# Altium schematic sheet Slot_periph.SchDoc: CPCI-Serial Backplane
size 594 x 420 mm; Date: 06/04/2023; CheckedBy: EG; GD; GK; MS; DrawnBy: M. Gąska; Address1: European Organization for Nuclear Research; Address2: CH-1211 Geneve 23 - Switzerland; DocumentNumber: 5; Revision: 2; SheetNumber: 5; SheetTotal: 5; Title2: Slot periph; DivGrp: BE-CO; Projet: DI/OT Crate; Designer: G.Daniluk; ModifiedBy: J.Kuhn; CreateDate: 06/04/2023; CheckedDate: 06/04/2023
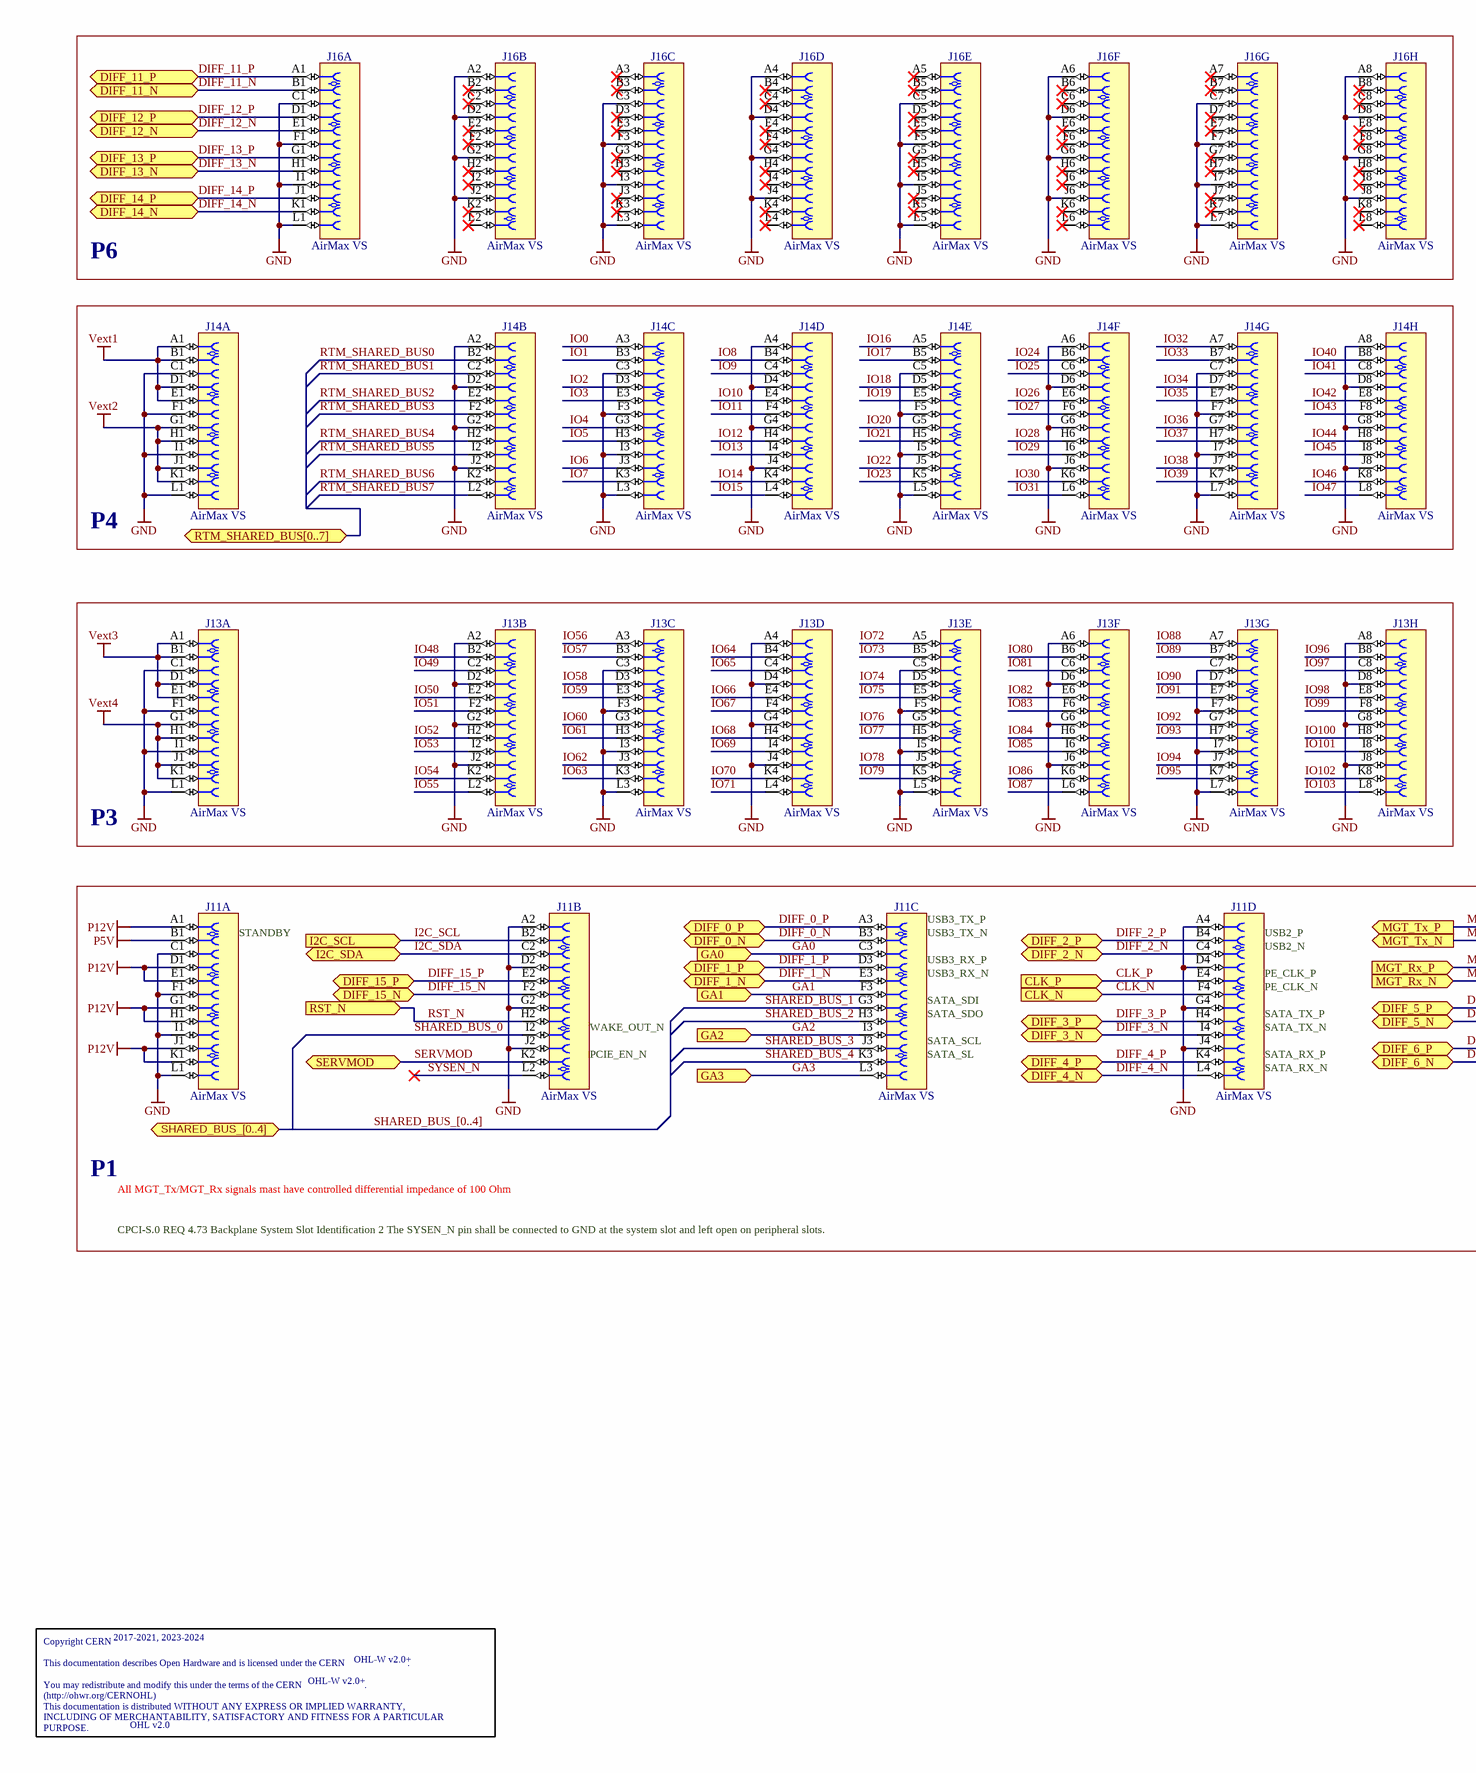
[diagram p0: Slot_periph.SchDoc, left]
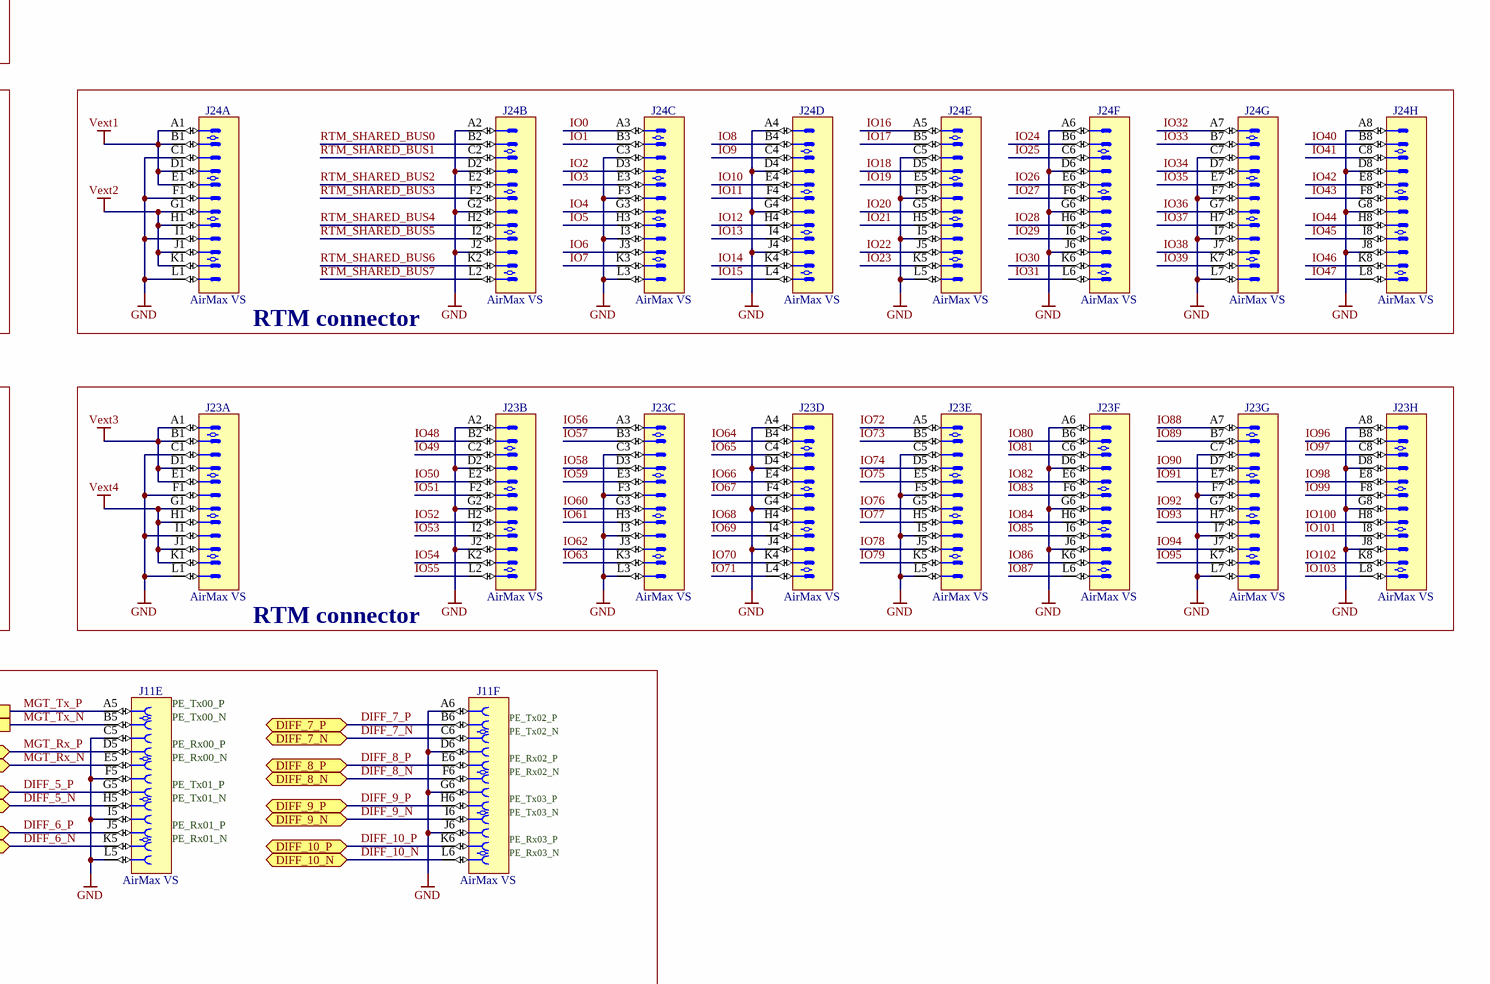
[diagram p1: Slot_periph.SchDoc, right]

## Parts
CERN_OHL  CERN_OHL  [CERN_OHL]  (value not drawn)  (graphical)
J11  AirMax VS  [AMPHENOL_10052829-101LF]  (parts A,B,C,D,E,F of 6)
J13  AirMax VS  [AMPHENOL_10052842-101LF]  (parts A,B,C,D,E,F,G,H of 8)
J14  AirMax VS  [AMPHENOL_10052842-101LF]  (parts A,B,C,D,E,F,G,H of 8)
J16  AirMax VS  [AMPHENOL_10052842-101LF]  (parts A,B,C,D,E,F,G,H of 8)
J23  AirMax VS  [AMPHENOL_10114760-101LF]  (parts A,B,C,D,E,F,G,H of 8)
J24  AirMax VS  [AMPHENOL_10114760-101LF]  (parts A,B,C,D,E,F,G,H of 8)

## Blocks framed on the sheet
P6: J16
P4: J14
RTM connector: J24
P3: J13
RTM connector: J23
P1: J11

## Ports
CLK_N (in), CLK_P (in), DIFF_0_N (bidir), DIFF_0_P (bidir), DIFF_1_N (bidir), DIFF_1_P (bidir), DIFF_2_N (bidir), DIFF_2_P (bidir), DIFF_3_N (bidir), DIFF_3_P (bidir), DIFF_4_N (bidir), DIFF_4_P (bidir), DIFF_5_N (bidir), DIFF_5_P (bidir), DIFF_6_N (bidir), DIFF_6_P (bidir), DIFF_7_N (bidir), DIFF_7_P (bidir), DIFF_8_N (bidir), DIFF_8_P (bidir), DIFF_9_N (bidir), DIFF_9_P (bidir), DIFF_10_N (bidir), DIFF_10_P (bidir), DIFF_11_N (bidir), DIFF_11_P (bidir), DIFF_12_N (bidir), DIFF_12_P (bidir), DIFF_13_N (bidir), DIFF_13_P (bidir), DIFF_14_N (bidir), DIFF_14_P (bidir), DIFF_15_N (bidir), DIFF_15_P (bidir), GA0 (in), GA1 (in), GA2 (in), GA3 (in), I2C_SCL (in), I2C_SDA (bidir), MGT_Rx_N (in), MGT_Rx_P (in), MGT_Tx_N (out), MGT_Tx_P (out), RST_N (in), RTM_SHARED_BUS[0..7] (bidir), SERVMOD (bidir), SHARED_BUS_[0..4] (bidir)

## Nets
GND: J11.A2 J11.A4 J11.A6 J11.C1 J11.C5 J11.D2 J11.D4 J11.D6 J11.F1 J11.F5 J11.G2 J11.G4 J11.G6 J11.I1 J11.I5 J11.J2 J11.J4 J11.J6 J11.L1 J11.L5 J13.A2 J13.A4 J13.A6 J13.A8 J13.C1 J13.C3 J13.C5 J13.C7 J13.D2 J13.D4 J13.D6 J13.D8 J13.F1 J13.F3 J13.F5 J13.F7 J13.G2 J13.G4 J13.G6 J13.G8 J13.I1 J13.I3 J13.I5 J13.I7 J13.J2 J13.J4 J13.J6 J13.J8 J13.L1 J13.L3 J13.L5 J13.L7 J14.A2 J14.A4 J14.A6 J14.A8 J14.C1 J14.C3 J14.C5 J14.C7 J14.D2 J14.D4 J14.D6 J14.D8 J14.F1 J14.F3 J14.F5 J14.F7 J14.G2 J14.G4 J14.G6 J14.G8 J14.I1 J14.I3 J14.I5 J14.I7 J14.J2 J14.J4 J14.J6 J14.J8 J14.L1 J14.L3 J14.L5 J14.L7 J16.A2 J16.A4 J16.A6 J16.A8 J16.C1 J16.C3 J16.C5 J16.C7 J16.D2 J16.D4 J16.D6 J16.D8 J16.F1 J16.F3 J16.F5 J16.F7 J16.G2 J16.G4 J16.G6 J16.G8 J16.I1 J16.I3 J16.I5 J16.I7 J16.J2 J16.J4 J16.J6 J16.J8 J16.L1 J16.L3 J16.L5 J16.L7 J23.A2 J23.A4 J23.A6 J23.A8 J23.C1 J23.C3 J23.C5 J23.C7 J23.D2 J23.D4 J23.D6 J23.D8 J23.F1 J23.F3 J23.F5 J23.F7 J23.G2 J23.G4 J23.G6 J23.G8 J23.I1 J23.I3 J23.I5 J23.I7 J23.J2 J23.J4 J23.J6 J23.J8 J23.L1 J23.L3 J23.L5 J23.L7 J24.A2 J24.A4 J24.A6 J24.A8 J24.C1 J24.C3 J24.C5 J24.C7 J24.D2 J24.D4 J24.D6 J24.D8 J24.F1 J24.F3 J24.F5 J24.F7 J24.G2 J24.G4 J24.G6 J24.G8 J24.I1 J24.I3 J24.I5 J24.I7 J24.J2 J24.J4 J24.J6 J24.J8 J24.L1 J24.L3 J24.L5 J24.L7
P5V: J11.B1
P12V: J11.A1 J11.D1 J11.E1 J11.G1 J11.H1 J11.J1 J11.K1
Vext1: J14.A1 J14.B1 J14.D1 J14.E1 J24.A1 J24.B1 J24.D1 J24.E1
Vext2: J14.G1 J14.H1 J14.J1 J14.K1 J24.G1 J24.H1 J24.J1 J24.K1
Vext3: J13.A1 J13.B1 J13.D1 J13.E1 J23.A1 J23.B1 J23.D1 J23.E1
Vext4: J13.G1 J13.H1 J13.J1 J13.K1 J23.G1 J23.H1 J23.J1 J23.K1
CLK_N: J11.F4 ; port CLK_N
CLK_P: J11.E4 ; port CLK_P
DIFF_0_N: J11.B3 ; port DIFF_0_N
DIFF_0_P: J11.A3 ; port DIFF_0_P
DIFF_1_N: J11.E3 ; port DIFF_1_N
DIFF_1_P: J11.D3 ; port DIFF_1_P
DIFF_2_N: J11.C4 ; port DIFF_2_N
DIFF_2_P: J11.B4 ; port DIFF_2_P
DIFF_3_N: J11.I4 ; port DIFF_3_N
DIFF_3_P: J11.H4 ; port DIFF_3_P
DIFF_4_N: J11.L4 ; port DIFF_4_N
DIFF_4_P: J11.K4 ; port DIFF_4_P
DIFF_5_N: J11.H5 ; port DIFF_5_N
DIFF_5_P: J11.G5 ; port DIFF_5_P
DIFF_6_N: J11.K5 ; port DIFF_6_N
DIFF_6_P: J11.J5 ; port DIFF_6_P
DIFF_7_N: J11.C6 ; port DIFF_7_N
DIFF_7_P: J11.B6 ; port DIFF_7_P
DIFF_8_N: J11.F6 ; port DIFF_8_N
DIFF_8_P: J11.E6 ; port DIFF_8_P
DIFF_9_N: J11.I6 ; port DIFF_9_N
DIFF_9_P: J11.H6 ; port DIFF_9_P
DIFF_10_N: J11.L6 ; port DIFF_10_N
DIFF_10_P: J11.K6 ; port DIFF_10_P
DIFF_11_N: J16.B1 ; port DIFF_11_N
DIFF_11_P: J16.A1 ; port DIFF_11_P
DIFF_12_N: J16.E1 ; port DIFF_12_N
DIFF_12_P: J16.D1 ; port DIFF_12_P
DIFF_13_N: J16.H1 ; port DIFF_13_N
DIFF_13_P: J16.G1 ; port DIFF_13_P
DIFF_14_N: J16.K1 ; port DIFF_14_N
DIFF_14_P: J16.J1 ; port DIFF_14_P
DIFF_15_N: J11.F2 ; port DIFF_15_N
DIFF_15_P: J11.E2 ; port DIFF_15_P
GA0: J11.C3 ; port GA0
GA1: J11.F3 ; port GA1
GA2: J11.I3 ; port GA2
GA3: J11.L3 ; port GA3
I2C_SCL: J11.B2 ; port I2C_SCL
I2C_SDA: J11.C2 ; port I2C_SDA
IO0: J14.A3 J24.A3
IO1: J14.B3 J24.B3
IO2: J14.D3 J24.D3
IO3: J14.E3 J24.E3
IO4: J14.G3 J24.G3
IO5: J14.H3 J24.H3
IO6: J14.J3 J24.J3
IO7: J14.K3 J24.K3
IO8: J14.B4 J24.B4
IO9: J14.C4 J24.C4
IO10: J14.E4 J24.E4
IO11: J14.F4 J24.F4
IO12: J14.H4 J24.H4
IO13: J14.I4 J24.I4
IO14: J14.K4 J24.K4
IO15: J14.L4 J24.L4
IO16: J14.A5 J24.A5
IO17: J14.B5 J24.B5
IO18: J14.D5 J24.D5
IO19: J14.E5 J24.E5
IO20: J14.G5 J24.G5
IO21: J14.H5 J24.H5
IO22: J14.J5 J24.J5
IO23: J14.K5 J24.K5
IO24: J14.B6 J24.B6
IO25: J14.C6 J24.C6
IO26: J14.E6 J24.E6
IO27: J14.F6 J24.F6
IO28: J14.H6 J24.H6
IO29: J14.I6 J24.I6
IO30: J14.K6 J24.K6
IO31: J14.L6 J24.L6
IO32: J14.A7 J24.A7
IO33: J14.B7 J24.B7
IO34: J14.D7 J24.D7
IO35: J14.E7 J24.E7
IO36: J14.G7 J24.G7
IO37: J14.H7 J24.H7
IO38: J14.J7 J24.J7
IO39: J14.K7 J24.K7
IO40: J14.B8 J24.B8
IO41: J14.C8 J24.C8
IO42: J14.E8 J24.E8
IO43: J14.F8 J24.F8
IO44: J14.H8 J24.H8
IO45: J14.I8 J24.I8
IO46: J14.K8 J24.K8
IO47: J14.L8 J24.L8
IO48: J13.B2 J23.B2
IO49: J13.C2 J23.C2
IO50: J13.E2 J23.E2
IO51: J13.F2 J23.F2
IO52: J13.H2 J23.H2
IO53: J13.I2 J23.I2
IO54: J13.K2 J23.K2
IO55: J13.L2 J23.L2
IO56: J13.A3 J23.A3
IO57: J13.B3 J23.B3
IO58: J13.D3 J23.D3
IO59: J13.E3 J23.E3
IO60: J13.G3 J23.G3
IO61: J13.H3 J23.H3
IO62: J13.J3 J23.J3
IO63: J13.K3 J23.K3
IO64: J13.B4 J23.B4
IO65: J13.C4 J23.C4
IO66: J13.E4 J23.E4
IO67: J13.F4 J23.F4
IO68: J13.H4 J23.H4
IO69: J13.I4 J23.I4
IO70: J13.K4 J23.K4
IO71: J13.L4 J23.L4
IO72: J13.A5 J23.A5
IO73: J13.B5 J23.B5
IO74: J13.D5 J23.D5
IO75: J13.E5 J23.E5
IO76: J13.G5 J23.G5
IO77: J13.H5 J23.H5
IO78: J13.J5 J23.J5
IO79: J13.K5 J23.K5
IO80: J13.B6 J23.B6
IO81: J13.C6 J23.C6
IO82: J13.E6 J23.E6
IO83: J13.F6 J23.F6
IO84: J13.H6 J23.H6
IO85: J13.I6 J23.I6
IO86: J13.K6 J23.K6
IO87: J13.L6 J23.L6
IO88: J13.A7 J23.A7
IO89: J13.B7 J23.B7
IO90: J13.D7 J23.D7
IO91: J13.E7 J23.E7
IO92: J13.G7 J23.G7
IO93: J13.H7 J23.H7
IO94: J13.J7 J23.J7
IO95: J13.K7 J23.K7
IO96: J13.B8 J23.B8
IO97: J13.C8 J23.C8
IO98: J13.E8 J23.E8
IO99: J13.F8 J23.F8
IO100: J13.H8 J23.H8
IO101: J13.I8 J23.I8
IO102: J13.K8 J23.K8
IO103: J13.L8 J23.L8
MGT_Rx_N: J11.E5 ; port MGT_Rx_N
MGT_Rx_P: J11.D5 ; port MGT_Rx_P
MGT_Tx_N: J11.B5 ; port MGT_Tx_N
MGT_Tx_P: J11.A5 ; port MGT_Tx_P
RST_N: J11.H2 ; port RST_N
RTM_SHARED_BUS0: J14.B2 J24.B2
RTM_SHARED_BUS1: J14.C2 J24.C2
RTM_SHARED_BUS2: J14.E2 J24.E2
RTM_SHARED_BUS3: J14.F2 J24.F2
RTM_SHARED_BUS4: J14.H2 J24.H2
RTM_SHARED_BUS5: J14.I2 J24.I2
RTM_SHARED_BUS6: J14.K2 J24.K2
RTM_SHARED_BUS7: J14.L2 J24.L2
SERVMOD: J11.K2 ; port SERVMOD
SHARED_BUS_0: J11.I2
SHARED_BUS_1: J11.G3
SHARED_BUS_2: J11.H3
SHARED_BUS_3: J11.J3
SHARED_BUS_4: J11.K3
SYSEN_N: J11.L2

Not connected (* = marked no-connect by the designer): J16 A3* A5* A7* B2* B3* B4* B5* B6* B7* B8* C2* C4* C6* C8* D3* D5* D7* E2* E3* E4* E5* E6* E7* E8* F2* F4* F6* F8* G3* G5* G7* H2* H3* H4* H5* H6* H7* H8* I2* I4* I6* I8* J3* J5* J7* K2* K3* K4* K5* K6* K7* K8* L2* L4* L6* L8*

## Buses and harness runs
bus SHARED_BUS_[0..4] = port SHARED_BUS_[0..4]

## Notes on the sheet
- (near J11) STANDBY
- (near J11) USB3_TX_P
- (near J11) USB3_TX_N
- (near J11) USB3_RX_P
- (near J11) USB3_RX_N
- (near J11) USB2_P
- (near J11) USB2_N
- (near J11) PE_CLK_P
- (near J11) PE_Tx00_P
- (near J11) PE_Tx00_N
- (near J11) PE_Rx00_P
- (near J11) PE_Rx00_N
- (near J11) PE_Rx02_P
- (near J11) PE_Tx02_N
- (near J11) PE_Tx02_P
- (near J11) WAKE_OUT_N
- (near J11) SATA_SDI
- (near J11) SATA_SDO
- (near J11) SATA_SCL
- (near J11) SATA_TX_P
- (near J11) SATA_TX_N
- (near J11) PE_CLK_N
- (near J11) PE_Rx01_P
- (near J11) PE_Tx01_N
- (near J11) PE_Tx01_P
- (near J11) PE_Tx03_P
- (near J11) PE_Tx03_N
- (near J11) PE_Rx02_N
- (near J11) PCIE_EN_N
- (near J11) SATA_SL
- (near J11) SATA_RX_P
- (near J11) SATA_RX_N
- (near J11) PE_Rx01_N
- (near J11) PE_Rx03_P
- (near J11) PE_Rx03_N
- All MGT_Tx/MGT_Rx signals mast have controlled differential impedance of 100 Ohm
- CPCI-S.0 REQ 4.73 Backplane System Slot Identification 2
  The SYSEN_N pin shall be connected to GND at the system slot and left open on peripheral slots.
- Project/Equipment
- Document
- File
- Designer
- Drawn by
- Check.by
- Last Mod.
- Print Date
- Sheet
- Size
- A2
- of
- Rev
- (in symbol CERN_OHL) Copyright CERN / This documentation describes Open Hardware and is licensed under the CERN                         . / You may redistribute and modify this under the terms of the CERN                         . / (http://ohwr.org/CERNOHL) / This documentation is distributed WITHOUT ANY EXPRESS OR IMPLIED WARRANTY, / INCLUDING OF MERCHANTABILITY, SATISFACTORY AND FITNESS FOR A PARTICULAR PURPOSE. / Please see the CERN                   for applicable conditions.

## Library data of the parts
CERN_OHL = CERN_OHL: Part Description: Copyright CERN; OHL_License: OHL-W v2.0+; OHL_Version: OHL v2.0; Mounted: No; OHL_Date: 2017-2021, 2023-2024; Part Number: CERN_OHL; Component Type: Standard (No BOM); Pin Count: 0; Socket: No; SMD: No; Sense: No; Status: None; ComponentHeight: 0mm; HelpURL: Undefined; Author: CERN DEM HF; CreateDate: 03/12/2021; LatestRevisionDate: 03/12/2021; PackageDescription: Texte Copyright Cern
J11 = AMPHENOL_10052829-101LF: 72 Contacts Receptacle, 6 Columns, 4 Pairs per Column; Part Description: 72 Contacts, 2mm Pitch, 6 Columns, 4 Pairs per Column, Vertical Receptacle; Part Number: AMPHENOL_10052829-101LF; Component Kind: Standard; Component Type: Standard; Pin Count: 72; Family: AirMax VS; Mounted: Yes; Socket: No; SMD: No; PressFit: Yes; Sense: No; Status: None; Manufacturer: AMPHENOL; Manufacturer Part Number: 10052829-101LF; ComponentHeight: 10.85mm; HelpURL: \\cern.ch\dfs\Applications\Altium\Datasheets\AMPHENOL_10052829-101LF.pdf; ComponentLink1URL: \\cern.ch\dfs\Applications\Altium\Datasheets\AMPHENOL_10052829-101LF_Application.pdf; ComponentLink1Description: Application; Author: CERN DEM MR; CreateDate: 30.04.2019; LatestRevisionDate: 30.04.2019
J13 J14 J16 = AMPHENOL_10052842-101LF: 96 Contacts Receptacle, 8 Columns, 4 Pairs per Column; Part Description: 96 Contacts, 2mm Pitch, 8 Columns, 4 Pairs per Column, Vertical Receptacle; Part Number: AMPHENOL_10052842-101LF; Component Kind: Standard; Component Type: Standard; Pin Count: 96; Family: AirMax VS; Mounted: Yes; Socket: No; SMD: No; PressFit: Yes; Sense: No; Status: None; Manufacturer: AMPHENOL; Manufacturer Part Number: 10052842-101LF; ComponentHeight: 10.85mm; HelpURL: \\cern.ch\dfs\Applications\Altium\Datasheets\AMPHENOL_10052842-101LF.pdf; ComponentLink1URL: \\cern.ch\dfs\Applications\Altium\Datasheets\AMPHENOL_10052842-101LF_Application.pdf; ComponentLink1Description: Application; Author: CERN DEM MR; CreateDate: 30.04.2019; LatestRevisionDate: 30.04.2019
J23 J24 = AMPHENOL_10114760-101LF: 96 Contacts Header, 8 Columns, 4 Pairs per Column; Part Description: 96 Contacts, 2mm Pitch, 8 Columns, 4 Pairs per Column, 2 Walls Vertical Header; Part Number: AMPHENOL_10114760-101LF; Component Kind: Standard; Component Type: Standard; Pin Count: 96; Family: AirMax VS; Mounted: Yes; Socket: No; SMD: No; PressFit: Yes; Sense: No; Status: None; Manufacturer: AMPHENOL; Manufacturer Part Number: 10114760-101LF; ComponentHeight: 12.45mm; HelpURL: \\cern.ch\dfs\Applications\Altium\Datasheets\AMPHENOL_10114760-101LF.pdf; ComponentLink1URL: \\cern.ch\dfs\Applications\Altium\Datasheets\AMPHENOL_10114760-101LF_Application.pdf; ComponentLink1Description: Application; Author: CERN DEM MR; CreateDate: 30.04.2019; LatestRevisionDate: 30.04.2019